# EasyEDA Pro project BlueberryPi.eprj, schematic BlueberryPi Board, sheets 9 to 13 of 13 (continued)
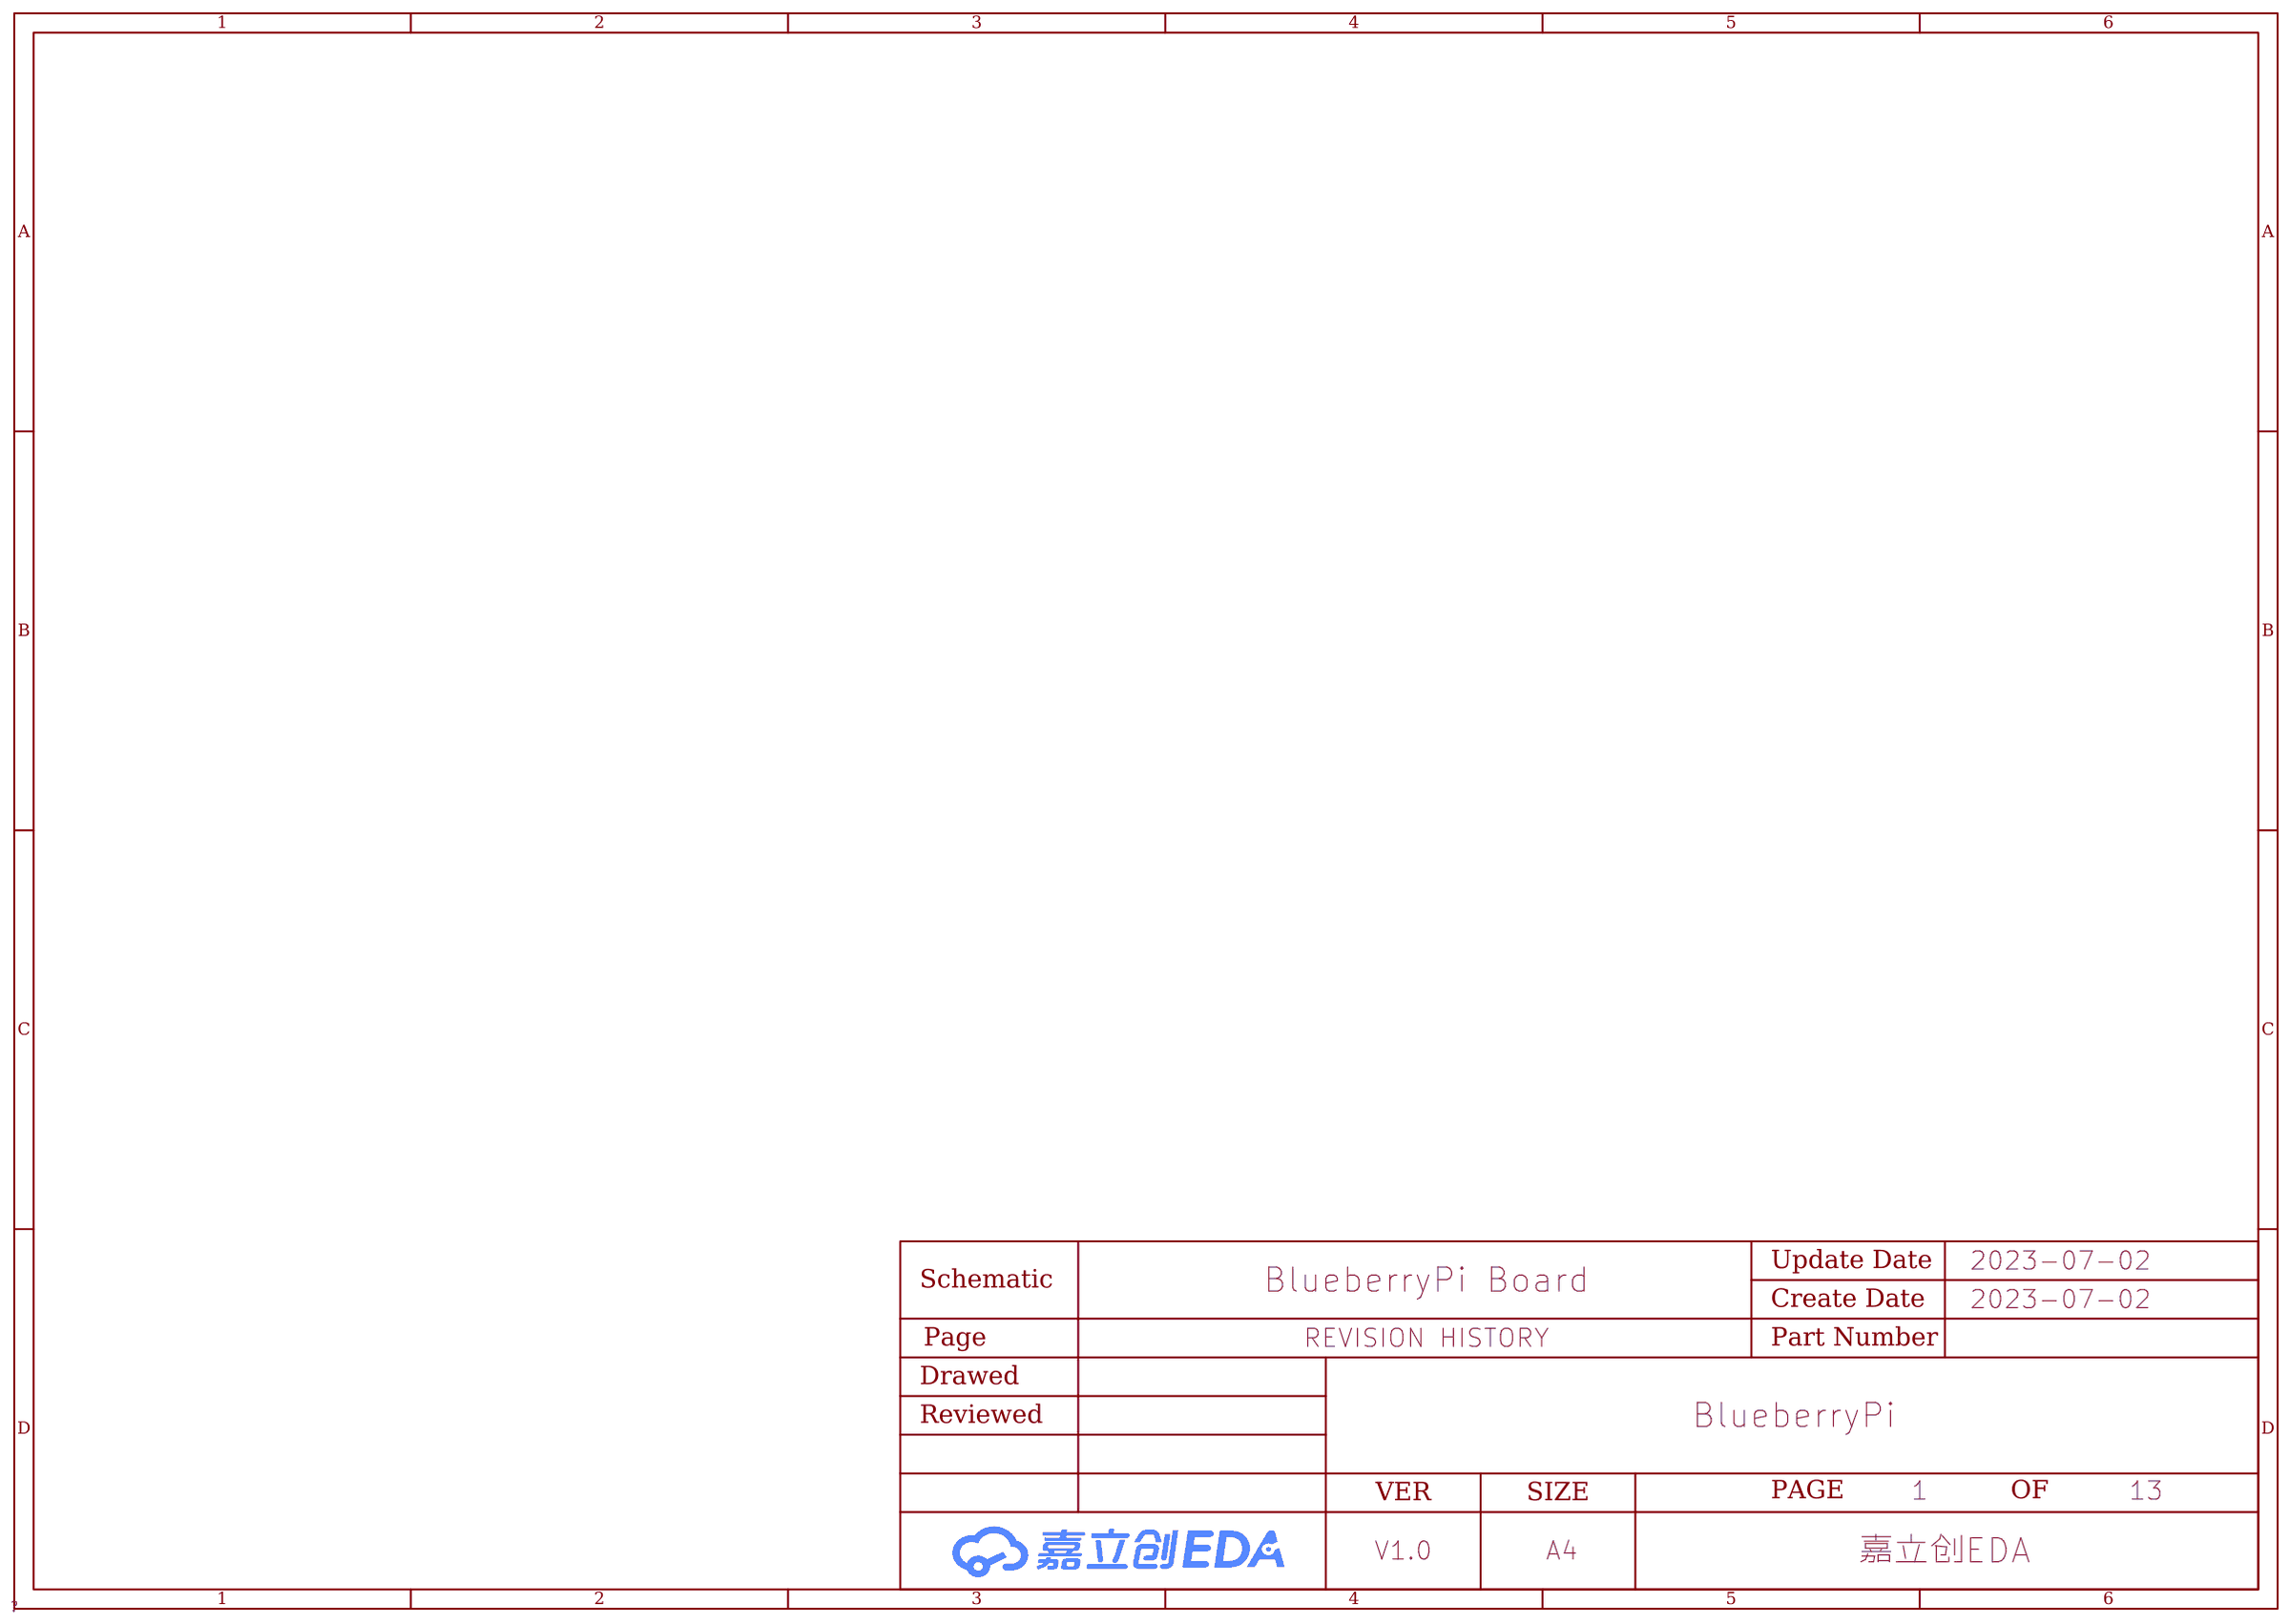
[diagram p0: REVISION HISTORY]
## Library data of the parts (continued)
C119 = CL05A225KO5NQNC: 容值:2.2uF;精度:±10%;额定电压:16V;材质(温度系数):X5R;; LCSC Part Name: 2.2uF ±10% 16V; Supplier Part: C170151; Manufacturer: SAMSUNG(三星); Supplier Footprint: 0402; JLCPCB Part Class: Extended Part; Datasheet: https://atta.szlcsc.com/upload/public/pdf/source/20180122/C170151_15166130056741291517.pdf; Supplier: LCSC; Tolerance: ±10%; Voltage Rated: 16V; Temperature Coefficient: X5R
R44 R45 = 0603WAF2001T5E: 电阻类型:厚膜电阻;阻值:2kΩ;精度:±1%;功率:100mW;温度系数:±100ppm/;最大工作电压:75V;工作温度范围:-55~+155;; LCSC Part Name: 2kΩ ±1% 100mW; Supplier Part: C22975; Manufacturer: UNI-ROYAL(厚声); Supplier Footprint: 0603; JLCPCB Part Class: 基础库; Datasheet: https://atta.szlcsc.com/upload/public/pdf/source/20200306/C422600_1E6D84923E4A46A82E41ADD87F860B5C.pdf; Supplier: LCSC; Type: 厚膜电阻; Tolerance: ±1%; Power(Watts): 100mW; Temperature Coefficient: ±100ppm/; Overload Voltage (Max): 75V; Operating Temperature Range: -55~+155
U7 = MTP125-1213S1: 间距:2.54mm;总PIN位数:26;排数:2;插针结构:2x13P;行距:2.54mm;安装类型:直插;圆针/方针:方针;额定电流:-;额定电压:-;配合针长度:6mm;塑高:2.5mm;端接针长度:3mm;触头材质:黄铜;触头镀层:-;工作温度范围:-40~+105;颜色:黑色;; LCSC Part Name: 2.54mm 2x13P 直插 方针; Supplier Part: C358701; Manufacturer: MINTRON(明硕); Supplier Footprint: 插件,P=2.54mm; JLCPCB Part Class: 扩展库; Datasheet: https://atta.szlcsc.com/upload/public/pdf/source/20190124/C358701_15F6CBA2A500A31D0922A54E086F18A5.pdf; Supplier: LCSC; Pitch: 2.54mm; Number of Pins: 26; Number of Rows: 2; Pin Structure: 2x13P; Row Spacing: 2.54mm; Mounting Type: 直插; Circluar Pins/Square Pins: 方针; Length of Mating Pin: 6mm; Insulation Height: 2.5mm; Length of End Connection Pin: 3mm; Contact Material: 黄铜; Operating Temperature Range: -40~+105; Color: 黑色
U39 = KLMAG1JETD-B041: 配置:-;接口类型:eMMC 5.1;顺序读/写:-;随机读/写:-;工作电压:2.7V~3.6V;工作温度:-25℃~+85℃;容量:16Gbit;; LCSC Part Name: eMMC 5.1 2.7V~3.6V 16Gbit; Supplier Part: C499919; Manufacturer: SAMSUNG(三星半导体); Supplier Footprint: FBGA-153; JLCPCB Part Class: Extended Part; Datasheet: https://atta.szlcsc.com/upload/public/pdf/source/20200701/C499919_1E98C18F4E9ED964C0713726F297C380.pdf; Supplier: LCSC; Interface Type: eMMC 5.1; Supply Voltage: 2.7V~3.6V; Operating Temperature: -25℃~+85℃; Density: 16Gbit
C132 = 0402B472K500NT: 容值:4.7nF;精度:±10%;额定电压:50V;材质(温度系数):X7R;; LCSC Part Name: 4.7nF ±10% 50V; Supplier Part: C1538; Manufacturer: FH(风华); Supplier Footprint: 0402; JLCPCB Part Class: Basic Part; Datasheet: https://atta.szlcsc.com/upload/public/pdf/source/20200305/C486355_26A10D38EF8C2A5C37091D0039909270.pdf; Supplier: LCSC; Tolerance: ±10%; Voltage Rated: 50V; Temperature Coefficient: X7R
C135 = CL05A474KA5NNNC: 容值:470nF;精度:±10%;额定电压:25V;材质(温度系数):X5R;; LCSC Part Name: 470nF ±10% 25V; Supplier Part: C92361; Manufacturer: SAMSUNG(三星); Supplier Footprint: 0402; JLCPCB Part Class: Extended Part; Datasheet: https://atta.szlcsc.com/upload/public/pdf/source/20180326/C92361_1C2FD0B5B6BBE480B5EC0C6D80BA9276.pdf; Supplier: LCSC; Tolerance: ±10%; Voltage Rated: 25V; Temperature Coefficient: X5R
H1 = HDR-F_2.54_1x3P: Supplier Part: C541850; Supplier Footprint: 插件
LED1 = LED_0603-R: Supplier Footprint: 0603
LED2 = LED_0603-G: Supplier Footprint: 0603
R57 R58 = 0603WAF3300T5E: 电阻类型:厚膜电阻;阻值:330Ω;精度:±1%;功率:100mW;; LCSC Part Name: 330Ω ±1% 100mW; Supplier Part: C23138; Manufacturer: UNI-ROYAL(厚声); Supplier Footprint: 0603; JLCPCB Part Class: Basic Part; Datasheet: https://atta.szlcsc.com/upload/public/pdf/source/20200306/C422600_1E6D84923E4A46A82E41ADD87F860B5C.pdf; Supplier: LCSC; Type: 厚膜电阻; Tolerance: ±1%; Power(Watts): 100mW; Temperature Coefficient: ±100ppm/℃; Overload Voltage (Max): 75V; Operating Temperature Range: -55℃~+155℃
R59-R61 R90 = 0402WGF1001TCE: 电阻类型:厚膜电阻;阻值:1kΩ;精度:±1%;功率:62.5mW;; LCSC Part Name: 1kΩ ±1% 62.5mW; Supplier Part: C11702; Manufacturer: UNI-ROYAL(厚声); Supplier Footprint: 0402; JLCPCB Part Class: Basic Part; Datasheet: https://atta.szlcsc.com/upload/public/pdf/source/20200306/C422600_1E6D84923E4A46A82E41ADD87F860B5C.pdf; Supplier: LCSC; Type: 厚膜电阻; Tolerance: ±1%; Power(Watts): 62.5mW; Temperature Coefficient: ±100ppm/℃; Overload Voltage (Max): 50V; Operating Temperature Range: -55℃~+155℃
SW1-SW4 = TS342A2P-WZ: LCSC Part Name: 轻触开关 3*4*2 两脚小龟不带柱 250gf 黑色塑胶按钮; Supplier Part: C557591; Manufacturer: SHOU HAN(首韩); Supplier Footprint: SMD; JLCPCB Part Class: 扩展库; Datasheet: https://atta.szlcsc.com/upload/public/pdf/source/20200519/C557591_B3A5A21584733303F06306F18577DA8B.pdf; Supplier: LCSC
C142 = 0402CG100J500NT: 容值:10pF;精度:±5%;额定电压:50V;材质(温度系数):C0G;; LCSC Part Name: 10pF ±5% 50V; Supplier Part: C1545; Manufacturer: FH(风华); Supplier Footprint: 0402; JLCPCB Part Class: Extended Part; Supplier: LCSC; Tolerance: ±5%; Voltage Rated: 50V; Temperature Coefficient: C0G
C143 C144 = 0402CG180J500NT: 容值:18pF;精度:±5%;额定电压:50V;材质(温度系数):C0G;; LCSC Part Name: 18pF ±5% 50V; Supplier Part: C1549; Manufacturer: FH(风华); Supplier Footprint: 0402; JLCPCB Part Class: Basic Part; Datasheet: https://atta.szlcsc.com/upload/public/pdf/source/20200305/C486355_26A10D38EF8C2A5C37091D0039909270.pdf; Supplier: LCSC; Tolerance: ±5%; Voltage Rated: 50V; Temperature Coefficient: C0G
C147 = CL05A105KA5NQNC: 容值:1uF;精度:±10%;额定电压:25V;材质(温度系数):X5R;; LCSC Part Name: 1uF ±10% 25V; Supplier Part: C52923; Manufacturer: SAMSUNG(三星); Supplier Footprint: 0402; JLCPCB Part Class: Basic Part; Datasheet: https://atta.szlcsc.com/upload/public/pdf/source/20160103/1457707735223.pdf; Supplier: LCSC; Tolerance: ±10%; Voltage Rated: 25V; Temperature Coefficient: X5R
C148 = 0402CG220J500NT: 容值:22pF;精度:±5%;额定电压:50V;材质(温度系数):C0G;; LCSC Part Name: 22pF ±5% 50V; Supplier Part: C1555; Manufacturer: FH(风华); Supplier Footprint: 0402; JLCPCB Part Class: Basic Part; Datasheet: https://atta.szlcsc.com/upload/public/pdf/source/20200305/C486355_26A10D38EF8C2A5C37091D0039909270.pdf; Supplier: LCSC; Tolerance: ±5%; Voltage Rated: 50V; Temperature Coefficient: C0G
JP1 = U.FL-R-SMT-1(80)_C88374: LCSC Part Name: 3310472280，IPE-X板端 IPX接头，贴片; Supplier Part: C88374; Manufacturer: HRS(广濑); Supplier Footprint: SMD; JLCPCB Part Class: 扩展库; Datasheet: https://atta.szlcsc.com/upload/public/pdf/source/20161125/1480067868647.pdf; Supplier: LCSC
L6 L7 = FNR6020S4R7MT: 电感值:4.7uH;精度:±20%;额定电流:2A;直流电阻(DCR):-;; LCSC Part Name: 4.7uH ±20% 2A; Supplier Part: C168008; Manufacturer: cjiang(长江微电); Supplier Footprint: SMD; JLCPCB Part Class: 扩展库; Datasheet: https://atta.szlcsc.com/upload/public/pdf/source/20190327/C168008_FDBE922C91270DF7813332514D07D8F1.pdf; Supplier: LCSC; Tolerance: ±20%; Rated Current: 2A
R75 R88 R89 = 0402WGF1003TCE: 电阻类型:厚膜电阻;阻值:100kΩ;精度:±1%;功率:62.5mW;; LCSC Part Name: 100kΩ ±1% 62.5mW; Supplier Part: C25741; Manufacturer: UNI-ROYAL(厚声); Supplier Footprint: 0402; JLCPCB Part Class: Basic Part; Datasheet: https://atta.szlcsc.com/upload/public/pdf/source/20200306/C422600_1E6D84923E4A46A82E41ADD87F860B5C.pdf; Supplier: LCSC; Type: 厚膜电阻; Tolerance: ±1%; Power(Watts): 62.5mW; Temperature Coefficient: ±100ppm/℃; Overload Voltage (Max): 50V; Operating Temperature Range: -55℃~+155℃
R91 = 0402WGF1503TCE: 电阻类型:厚膜电阻;阻值:150kΩ;精度:±1%;功率:62.5mW;; LCSC Part Name: 150kΩ ±1% 62.5mW; Supplier Part: C25755; Manufacturer: UNI-ROYAL(厚声); Supplier Footprint: 0402; JLCPCB Part Class: Basic Part; Datasheet: https://atta.szlcsc.com/upload/public/pdf/source/20200306/C422600_1E6D84923E4A46A82E41ADD87F860B5C.pdf; Supplier: LCSC; Type: 厚膜电阻; Tolerance: ±1%; Power(Watts): 62.5mW; Temperature Coefficient: ±100ppm/℃; Overload Voltage (Max): 50V; Operating Temperature Range: -55℃~+155℃
R92 = 0402WGF3302TCE: 电阻类型:厚膜电阻;阻值:33kΩ;精度:±1%;功率:62.5mW;; LCSC Part Name: 33kΩ ±1% 62.5mW; Supplier Part: C25779; Manufacturer: UNI-ROYAL(厚声); Supplier Footprint: 0402; JLCPCB Part Class: Basic Part; Datasheet: https://atta.szlcsc.com/upload/public/pdf/source/20200306/C422600_1E6D84923E4A46A82E41ADD87F860B5C.pdf; Supplier: LCSC; Type: 厚膜电阻; Tolerance: ±1%; Power(Watts): 62.5mW; Temperature Coefficient: ±100ppm/℃; Overload Voltage (Max): 50V; Operating Temperature Range: -55℃~+155℃
U64 = AP6212: 频率:2.4GHz;发射功率:16dBm;核心处理器:-;天线形式:-;接收灵敏度:-90dBm;; Supplier Part: C2798300; Manufacturer: AMPAK(正基科技); Supplier Footprint: QFN-44(12x12); JLCPCB Part Class: Extended Part; Datasheet: https://atta.szlcsc.com/upload/public/pdf/source/20211112/AA78F03D5C0D0696D3667FAF5868FDF6.pdf; Supplier: LCSC; Output Power: 16dBm; Support Interface: UART; Wireless Standard: 802.11b/g/n; Sensitivity: -90dBm; Operating Temperature: -30℃~+85℃
U65 = SY8089A1AAC: Supplier Part: C479074; Manufacturer: silergy(矽力杰); Supplier Footprint: SOT-23-5; JLCPCB Part Class: Extended Part; Datasheet: https://atta.szlcsc.com/upload/public/pdf/source/20200117/C479074_09E605B8BDE11DB5A08573B7E6429A0D.pdf; Supplier: LCSC
U66 = ME6212C18M5G: 输出类型:固定;输出极性:正;最大输入电压:6V;输出电压:1.8V;输出电流:250mA;电源纹波抑制比(PSRR):65dB;; LCSC Part Name: 输入6V 输出1.8V 250mA; Supplier Part: C236669; Manufacturer: MICRONE(南京微盟); Supplier Footprint: SOT-23-5; JLCPCB Part Class: Extended Part; Datasheet: https://atta.szlcsc.com/upload/public/pdf/source/20180709/C236669_29DDD08275525FA015CEDF3C5F4ADA1E.pdf; Supplier: LCSC; Output Type: 固定; Output Polarity: 正; Number of Outputs: 1; Maximum Input Voltage: 6V; Output Voltage: 1.8V; Dropout Voltage: 400mV@(200mA); Output Current: 250mA; Power Supply Rejection Ratio (PSRR): 65dB
X3 = TAXM26M4RLBCCT2T: 晶振类型:SMD 谐振器;频率:26MHz;频率公差:±10ppm;频率稳定度:±50ppm;负载电容:20pF;等效串联电阻(ESR):80Ω;工作温度:-;; LCSC Part Name: 26MHz ±10ppm 20pF; Supplier Part: C164050; Manufacturer: TAE(雅晶鑫); Supplier Footprint: SMD3225-4P; JLCPCB Part Class: 扩展库; Datasheet: https://atta.szlcsc.com/upload/public/pdf/source/20171225/C164050_15141924851571203409.pdf; Supplier: LCSC; Crystal Type: SMD 谐振器; Frequency Tolerance: ±10ppm; Frequency Stability: ±50ppm; Load Capacitance: 20pF; Equivalent Series Resistance (ESR): 80Ω

## Nets
GND: AUDIO1.1 C119.1 C120.1 C121.1 C122.1 C123.1 C124.1 C125.1 C126.1 C127.1 C128.1 C129.1 C130.1 C131.1 C132.1 C133.1 C134.1 C135.1 C138.1 C139.1 C140.1 C141.1 C143.2 C144.2 C145.1 C146.1 C147.2 C149.2 C150.2 C151.1 C152.1 C153.1 CARD1.6(VSS) CARD1.10(GND) CARD1.11(GND) CARD1.12(GND) CARD1.13(GND) CN1.2(TMDS_DATA2_SHIELD) CN1.5(TMDS_DATA1_SHIELD) CN1.8(TMDS_DATA0_SHIELD) CN1.11(TMDS_CLOCK_SHIELD) CN1.17(DDC/CEC_GND) CN1.20(SHIELD) CN1.21(SHIELD) CN1.22(SHIELD) CN1.23(SHIELD) D2.3(GND) D2.8(GND) D3.3(GND) D3.8(GND) D4.3(GND) D4.8(GND) H1.3 JP1.2(GND) JP1.3(GND) LED1.1(C) LED2.1(C) R43.1 R50.2 R52.2 R54.2 R75.1 R88.1 R89.1 R92.2 SW1.1 SW2.1 SW3.1 SW4.1 U7.6 U7.9 U7.14 U7.20 U7.25 U25.1(K) U39.A6(VSS) U39.C4(VSS) U39.E7(VSS) U39.G5(VSS) U39.H10(VSS) U39.J5(VSS) U39.K8(VSS) U39.N2(VSS) U39.N5(VSS) U39.P4(VSS) U39.P6(VSS) U40.1(K) U41.1(K) U42.1(K) U43.1(K) U44.1(K) U45.1(K) U47.1(K) U49.1(K) U50.2(GND) U51.1(K) U52.1(K) U53.2(GND) U54.2(GND) U55.1(K) U56.1(K) U57.1(K) U58.1(K) U59.1(K) U60.1(K) U61.1(K) U62.1(K) U63.1(K) U64.1(GND) U64.3(GND) U64.20(GND) U64.31(GND) U64.33(GND) U64.36(GND) U65.2(GND) U66.2(VSS) USB2.4(GND) USB2.5 USB2.6 USB2.7 USB3.4(GND1) USB3.7(GND_DRAIN1) USB3.13(GND2) USB3.16(GND_DRAIN2) USB3.19(Shield) USB3.20(Shield) USB3.21(Shield) USB3.22(Shield) X3.2(GND) X3.4(GND) ; also on sheet 5 6 7 8
VCC33-WIFI: C139.2 C148.2 C149.1 C150.1 C151.2 L7.1 R91.2 U64.9(VBAT) U66.1(VIN) U66.3(CE) ; also on sheet 8
VCC-DCXOIO: C140.2 R77.2 R78.2 R79.2 R80.2 R81.2 R82.2 R83.2 R84.2 R85.2 R86.2 R93.2 U64.22(VDDIO) ; also on sheet 5 6 8
VCC-PC: C123.2 C124.2 R42.1 U39.C6(VDD) U39.M4(VDD) U39.N4(VDD) U39.P3(VDD) U39.P5(VDD) ; also on sheet 5 8
VDDI-EMMC: C119.2 C120.2 U39.C2(VDDI)
ALDO1: R62.2 ; also on sheet 5 8
ALDO3: C121.2 C122.2 D5.2(A) Q1.1(G) Q4.1(G) R44.2 R45.2 R48.1 R56.2 R66.2 R69.1 R70.2 R72.2 U7.1 U7.17 U39.E6(VDDF) U39.F5(VDDF) U39.J10(VDDF) U39.K9(VDDF) ; also on sheet 5 6 8
AP-CK32KO: R76.2 R86.1 ; also on sheet 6
AP-RESET: C132.2 R59.2 ; also on sheet 6 8
AP-WAKE-BT: R88.2 U64.6(BT_WAKE) ; also on sheet 5
BT-PCM-CLK: U64.26(PCM_CLK) ; also on sheet 5
BT-PCM-DIN: U64.27(PCM_IN) ; also on sheet 5
BT-PCM-DOUT: U64.25(PCM_OUT) ; also on sheet 5
BT-PCM-SYNC: U64.28(PCM_SYNC) ; also on sheet 5
BT-REG-ON: R87.2 R89.2 ; also on sheet 5
BT-UART-CTS: R80.1 U64.44(UART_CTS_N) ; also on sheet 5
BT-UART-RTS: R77.1 U64.41(UART_RTS_N) ; also on sheet 5
BT-UART-RX: R79.1 U64.43(UART_RXD) ; also on sheet 5
BT-UART-TX: R78.1 U64.42(UART_TXD) ; also on sheet 5
BT-WAKE-AP: U64.7(BT_HOST_WAKE) ; also on sheet 5
CPUX-URX: Q1.2(S) R56.1 ; also on sheet 5
CPUX-UTX: R55.1 ; also on sheet 5
DDC_CEC_EN: R68.1 ; also on sheet 5
EMMC-CLK: U39.M6(CLK) ; also on sheet 5
EMMC-CMD: R42.2 U39.M5(CMD) ; also on sheet 5
EMMC-D0: U39.A3(DAT0) ; also on sheet 5
EMMC-D1: U39.A4(DAT1) ; also on sheet 5
EMMC-D2: U39.A5(DAT2) ; also on sheet 5
EMMC-D3: U39.B2(DAT3) ; also on sheet 5
EMMC-D4: U39.B3(DAT4) ; also on sheet 5
EMMC-D5: U39.B4(DAT5) ; also on sheet 5
EMMC-D6: U39.B5(DAT6) ; also on sheet 5
EMMC-D7: U39.B6(DAT7) ; also on sheet 5
EMMC-DS: R43.2 U39.H5(DataStrobe) ; also on sheet 5
EMMC-RST: U39.K5(RSTN) ; also on sheet 5
HCEC: Q4.2(S) R72.1 ; also on sheet 5
HDMI-5V: CN1.18(+5V) D6.1(C) R67.2 R71.2 U59.2(A)
HDMI-CEC: CN1.13(CEC) Q4.3(D) R73.1 U63.2(A)
HDMI-SCL: CN1.15(SCL) Q2.3(D) R67.1 U62.2(A)
HDMI-SDA: CN1.16(SDA) Q3.3(D) R71.1 U61.2(A)
HHPD: C138.2 R65.1 ; also on sheet 6
HOST3_DM: U58.2(A) USB3.2(D1-) ; also on sheet 6
HOST3_DP: U57.2(A) USB3.3(D1+) ; also on sheet 6
HSCL: Q2.2(S) R66.1 ; also on sheet 5
HSDA: Q3.2(S) R70.1 ; also on sheet 5
HTX0N: CN1.9(TMDS_DATA0-) D3.2(Line-2) D3.9(NC) ; also on sheet 6
HTX0P: CN1.7(TMDS_DATA0+) D3.1(Line-1) D3.10(NC) ; also on sheet 6
HTX1N: CN1.6(TMDS_DATA1-) D4.5(Line-4) D4.6(NC) ; also on sheet 6
HTX1P: CN1.4(TMDS_DATA1+) D4.4(Line-3) D4.7(NC) ; also on sheet 6
HTX2N: CN1.3(TMDS_DATA2-) D4.2(Line-2) D4.9(NC) ; also on sheet 6
HTX2P: CN1.1(TMDS_DATA2+) D4.1(Line-1) D4.10(NC) ; also on sheet 6
HTXCN: CN1.12(TMDS_CLOCK-) D3.5(Line-4) D3.6(NC) ; also on sheet 6
HTXCP: CN1.10(TMDS_CLOCK+) D3.4(Line-3) D3.7(NC) ; also on sheet 6
LINEOUTL: C136.1 ; also on sheet 6
LINEOUTR: C137.1 ; also on sheet 6
PD15: U7.16 ; also on sheet 5
PD16: U7.18 ; also on sheet 5
PD18: U7.12 ; also on sheet 5
PD21: U7.22 ; also on sheet 5
PL8: U7.26 ; also on sheet 5
PL10: U7.15 ; also on sheet 5
PS: C145.2 C146.2 D6.2(A) R49.1 R51.1 R53.1 U7.2 U7.4 U50.5(IN) U53.5(IN) U54.5(IN) U65.4(IN) ; also on sheet 8
PWM0: U7.7 ; also on sheet 5
PWR-LED: R57.1 ; also on sheet 5
PWRON: C134.2 R61.2 ; also on sheet 8
RECOVERY: C135.2 R62.1 SW4.2 U25.2(A) ; also on sheet 5
S-UART-RX: U7.10 ; also on sheet 5
S-UART-TX: U7.8 ; also on sheet 5
SDC0-CLK: CARD1.5(CLK(SCLK)) U45.2(A) ; also on sheet 5
SDC0-CMD: CARD1.3(CMD(DI)) R46.1 U43.2(A) ; also on sheet 5
SDC0-D0: CARD1.7(DAT0(D0)) U47.2(A) ; also on sheet 5
SDC0-D1: CARD1.8(DAT1(RSV)) U40.2(A) ; also on sheet 5
SDC0-D2: CARD1.1(DAT2(RSV)) U41.2(A) ; also on sheet 5
SDC0-D3: CARD1.2(CDDAT3(CS)) U42.2(A) ; also on sheet 5
SDC0-DET: CARD1.9(CD) R47.1 U49.2(A) ; also on sheet 5
SPI1-CLK: U7.23 ; also on sheet 5
SPI1-CS: U7.24 ; also on sheet 5
SPI1-MISO: U7.21 ; also on sheet 5
SPI1-MOSI: U7.19 ; also on sheet 5
STATUS-LED: R58.1 ; also on sheet 5
TWI0-SCK: R45.1 U7.5 ; also on sheet 5
TWI0-SDA: R44.1 U7.3 ; also on sheet 5
UART3-RX: U7.11 ; also on sheet 5
UART3-TX: U7.13 ; also on sheet 5
UBOOT: C133.2 R60.2 ; also on sheet 6
USB0-DM: U51.2(A) USB2.2(D-) ; also on sheet 6
USB0-DP: U52.2(A) USB2.3(D+) ; also on sheet 6
USB1-DM: U56.2(A) USB3.11(D2-) ; also on sheet 6
USB1-DP: U55.2(A) USB3.12(D2+) ; also on sheet 6
USB1-SSRXN: D2.1(Line-1) D2.10(NC) USB3.14(StdA_SSRX2-) ; also on sheet 6
USB1-SSRXP: D2.2(Line-2) D2.9(NC) USB3.15(StdA_SSRX2+) ; also on sheet 6
USB1-SSTXN: D2.4(Line-3) D2.7(NC) USB3.17(StdA_SSTX2-) ; also on sheet 6
USB1-SSTXP: D2.5(Line-4) D2.6(NC) USB3.18(StdA_SSTX2+) ; also on sheet 6
USB-VBUS0: C126.2 C127.2 U50.1(OUT) USB2.1(VCC)
USB-VBUS1: C130.2 C131.2 U53.1(OUT) USB3.10(VBUS2)
USB-VBUS3: C128.2 C129.2 U54.1(OUT) USB3.1(VBUS1)
WIFI-CLK-IN: C143.1 U64.10(XTAL_IN) X3.1(OSC1)
WIFI-CLK-OUT: C144.1 U64.11(XTAL_OUT) X3.3(OSC2)
WIFI-PWR-EN: R90.1 ; also on sheet 5
WL-REG-ON: R75.2 U64.12(WL_REG_ON) ; also on sheet 5
WL-SDIO-CLK: U64.17(SDIO_DATA_CLK) ; also on sheet 5
WL-SDIO-CMD: R83.1 U64.16(SDIO_DATA_CMD) ; also on sheet 5
WL-SDIO-D0: R84.1 U64.18(SDIO_DATA_0) ; also on sheet 5
WL-SDIO-D1: R85.1 U64.19(SDIO_DATA_1) ; also on sheet 5
WL-SDIO-D2: R81.1 U64.14(SDIO_DATA_2) ; also on sheet 5
WL-SDIO-D3: R82.1 U64.15(SDIO_DATA_3) ; also on sheet 5
WL-WAKE-AP: U64.13(WL_HOST_WAKE) ; also on sheet 5
$AUDIO1_2: AUDIO1.2 AUDIO1.4 R64.2
$AUDIO1_3: AUDIO1.3 R63.2
$C125_2: C125.2 CARD1.4(VDD) R46.2 R47.2 R48.2 U44.2(A)
$C136_2: C136.2 R63.1
$C137_2: C137.2 R64.1
$C141_2: C141.2 L6.1 U64.23(VIN_LDO)
$C142_1: C142.1 JP1.1(SIG)
$C142_2: C142.2 U64.2(WL_BT_ANT)
$C147_1: C147.1 R90.2 U65.1(EN)
$C148_1: C148.1 R91.1 R92.1 U65.5(FB)
$C152_2: C152.2 C153.2 R93.1 U66.5(VOUT)
$CN1_19: CN1.19(HOT_PLUG_DET) R65.2 U60.2(A)
$D5_1: D5.1(C) R73.2
$H1_1: H1.1 R55.2
$H1_2: H1.2 Q1.3(D)
$L6_2: L6.2 U64.21(VIN_LDO_OUT)
$L7_2: L7.2 U65.3(LX)
$LED1_2: LED1.2(A) R57.2
$LED2_2: LED2.2(A) R58.2
$Q2_1: Q2.1(G) Q3.1(G) R68.2 R69.2
$R49_2: R49.2 U50.4(EN)
$R50_1: R50.1 U50.3(ISET)
$R51_2: R51.2 U53.4(EN)
$R52_1: R52.1 U53.3(ISET)
$R53_2: R53.2 U54.4(EN)
$R54_1: R54.1 U54.3(ISET)
$R59_1: R59.1 SW1.2
$R60_1: R60.1 SW2.2
$R61_1: R61.1 SW3.2
$R76_1: R76.1 U64.24(LPO)
$R87_1: R87.1 U64.34(BT_RST_N)

Not connected (* = marked no-connect by the designer): CN1 14(UTILITY)*; U39 A1(NC)* A2(NC)* A7(RFU)* A8(NC)* A9(NC)* A10(NC)* A11(NC)* A12(NC)* A13(NC)* A14(NC)* B1(NC)* B7(NC)* B8(NC)* B9(NC)* B10(NC)* B11(NC)* B12(NC)* B13(NC)* B14(NC)* C1(NC)* C3(NC)* C5(NC)* C7(NC)* C8(NC)* C9(NC)* C10(NC)* C11(NC)* C12(NC)* C13(NC)* C14(NC)* D1(NC)* D2(NC)* D3(NC)* D4(NC)* D12(NC)* D13(NC)* D14(NC)* E1(NC)* E2(NC)* E3(NC)* E5(RFU)* E8(RFU)* E9(RFU)* E10(RFU)* E12(NC)* E13(NC)* E14(NC)* F1(NC)* F2(NC)* F3(NC)* F10(RFU)* F12(NC)* F13(NC)* F14(NC)* G1(NC)* G2(NC)* G3(RFU)* G10(RFU)* G12(NC)* G13(NC)* G14(NC)* H1(NC)* H2(NC)* H3(NC)* H12(NC)* H13(NC)* H14(NC)* J1(NC)* J2(NC)* J3(NC)* J12(NC)* J13(NC)* J14(NC)* K1(NC)* K2(NC)* K3(NC)* K6(RFU)* K7(RFU)* K10(RFU)* K12(NC)* K13(NC)* K14(NC)* L1(NC)* L2(NC)* L3(NC)* L12(NC)* L13(NC)* L14(NC)* M1(NC)* M2(NC)* M3(NC)* M7(NC)* M8(NC)* M9(NC)* M10(NC)* M11(NC)* M12(NC)* M13(NC)* M14(NC)* N1(NC)* N3(NC)* N6(NC)* N7(NC)* N8(NC)* N9(NC)* N10(NC)* N11(NC)* N12(NC)* N13(NC)* N14(NC)* P1(NC)* P2(NC)* P7(RFU)* P8(NC)* P9(NC)* P10(RFU)* P11(NC)* P12(NC)* P13(NC)* P14(NC)*; U64 4(FM_RX)* 5(NC)* 8(CLK_REQ)* 29(NC)* 30(NC)* 32(NC)* 35(NC)* 37(GPIO4)* 38(GPIO3)* 39(GPIO2)* 40(GPIO1)* 45(TP1)* 46(TP2)* 47(TP3(NC))*; U66 4(NC)*; USB3 5(StdA_SSRX1-)* 6(StdA_SSRX1+)* 8(StdA_SSTX1-)* 9(StdA_SSTX1+)*

## Notes on the sheets
sheet 9
- eMMC
- GPIO
- 3.3V
- 5.0V
- SDA
- 5.0V
- SCK
- GND
- S-PWM1
- TXD0
- 此处可能会遇到走线困难的问题，可以将NC焊盘做走线媒介
- GND
- RXD0
- IO_0
- IO_2
- GND
- IO_1
- IO_3
- IO_4
- 3.3V
- IO_5
- SPI_MOSI
- GND
- SPI_MISO
- IO_6
- SPI_CLK
- SPI_CE0
- GND
- S-PWM0
sheet 10
- CARD
- USB
- 90ohm阻抗
- OrangePi这里画反了
- USB3.0
sheet 11
- DEBUG
- LED
- KEY
sheet 12
- AUDIO
- HDMI
- 100ohm阻抗
- OrangePi里面这里
  是一个104电阻，怀疑有错
sheet 13
- 50ohm
- OrangePi中为NC
- 不知道接不接
  倾向于不接
- OrangePi中为NC
- 5V->3.3V/2A
- 3.3V->1.8V
